# EasyEDA Pro project C108_STM32.eprj, board PCB3
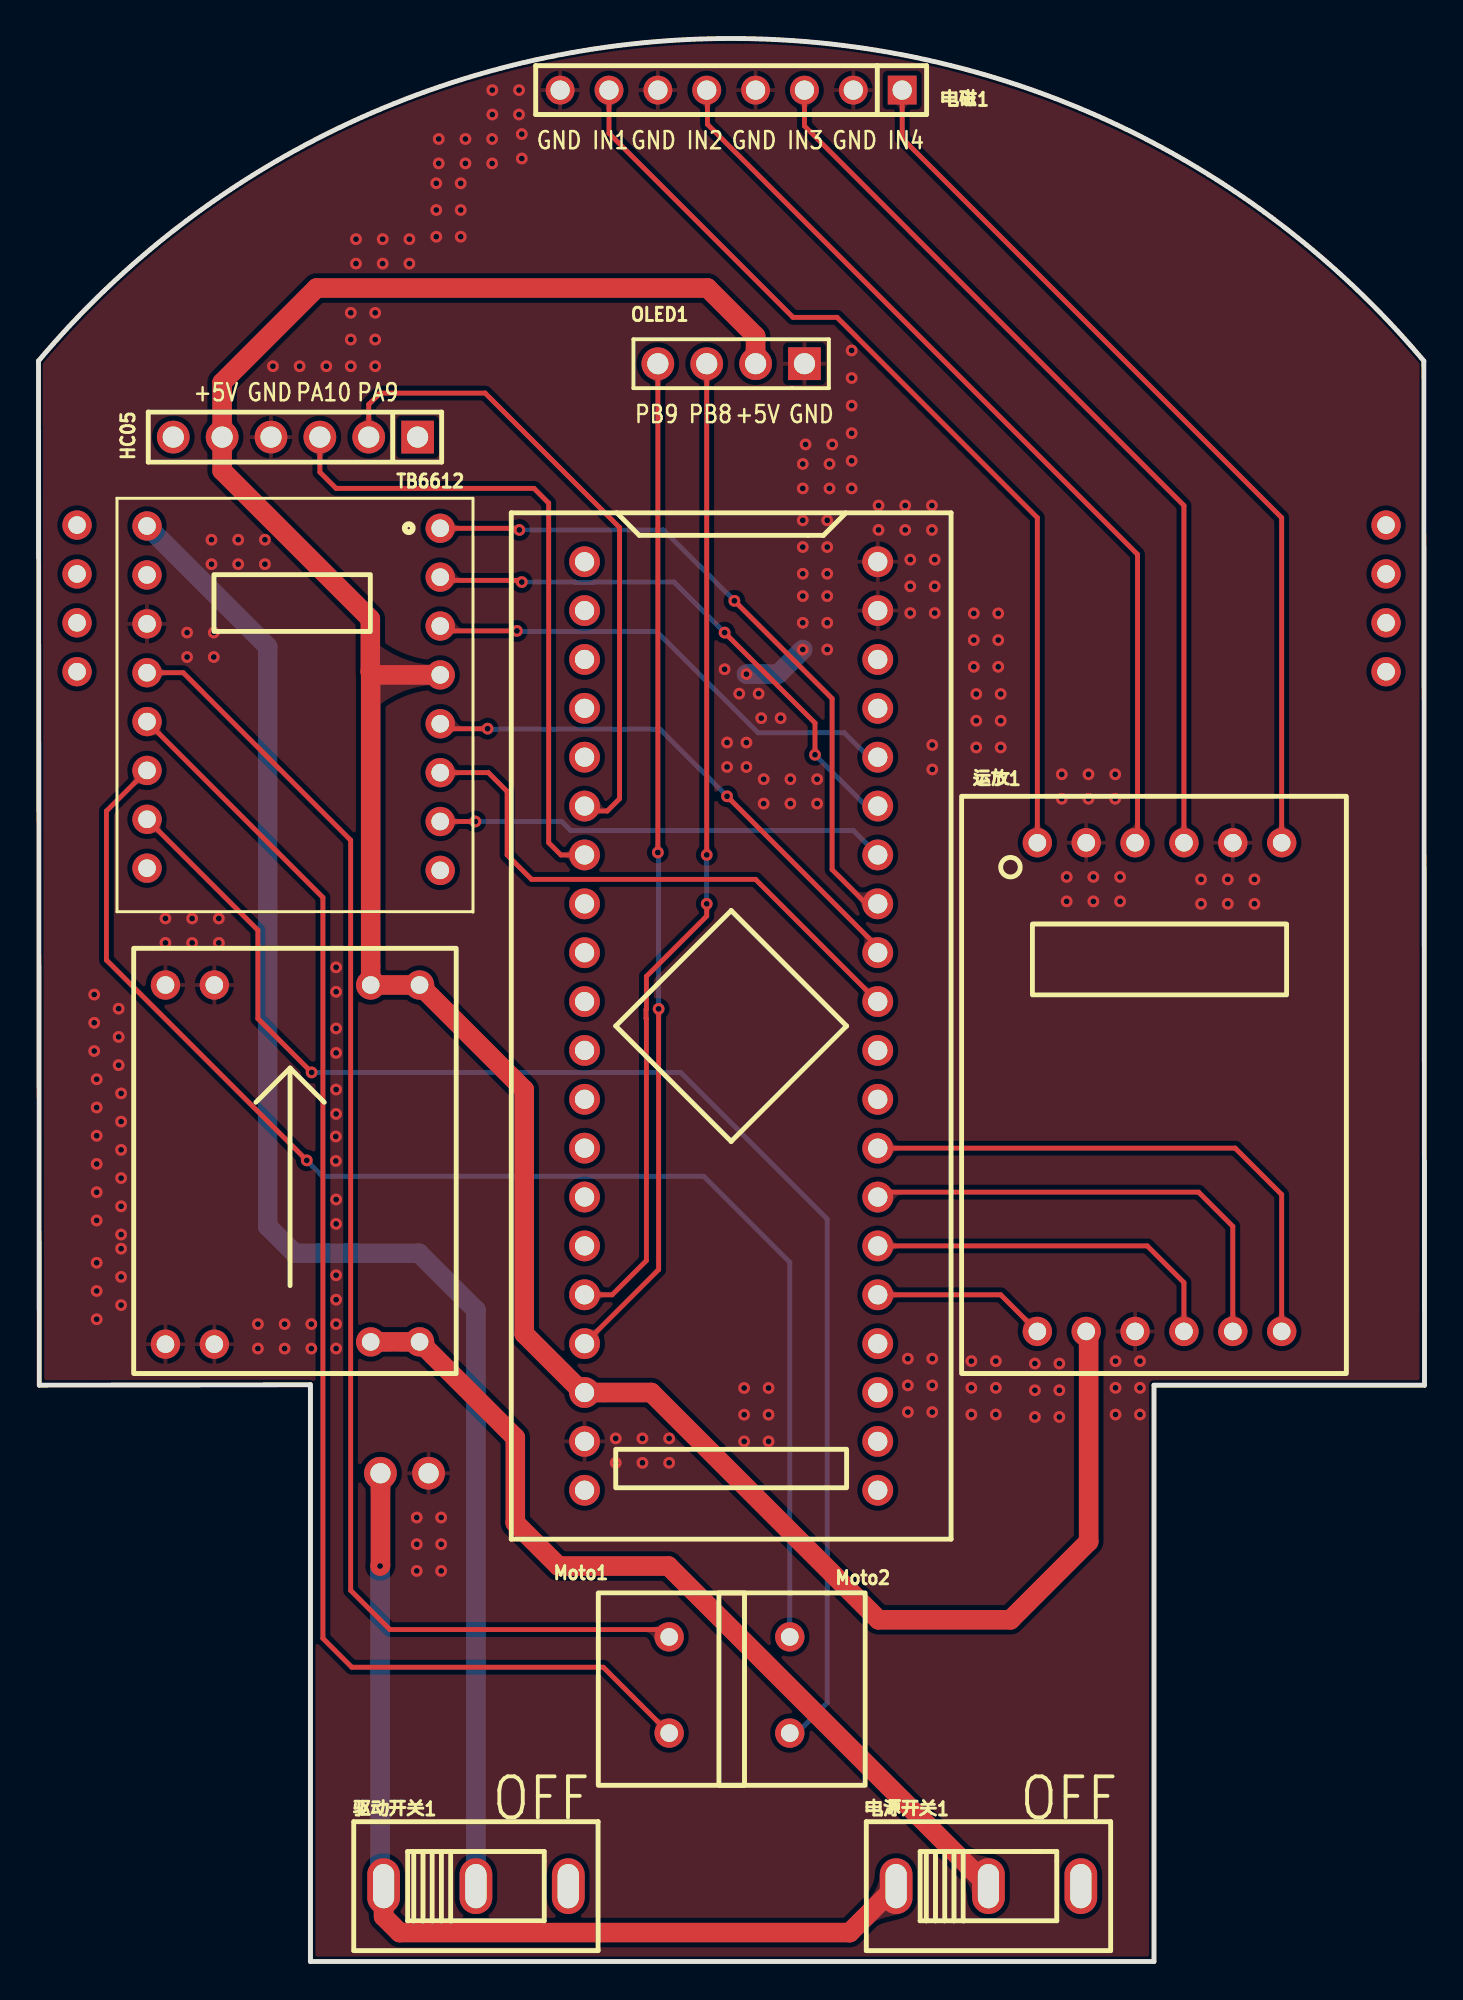
[diagram p13: board, top side]
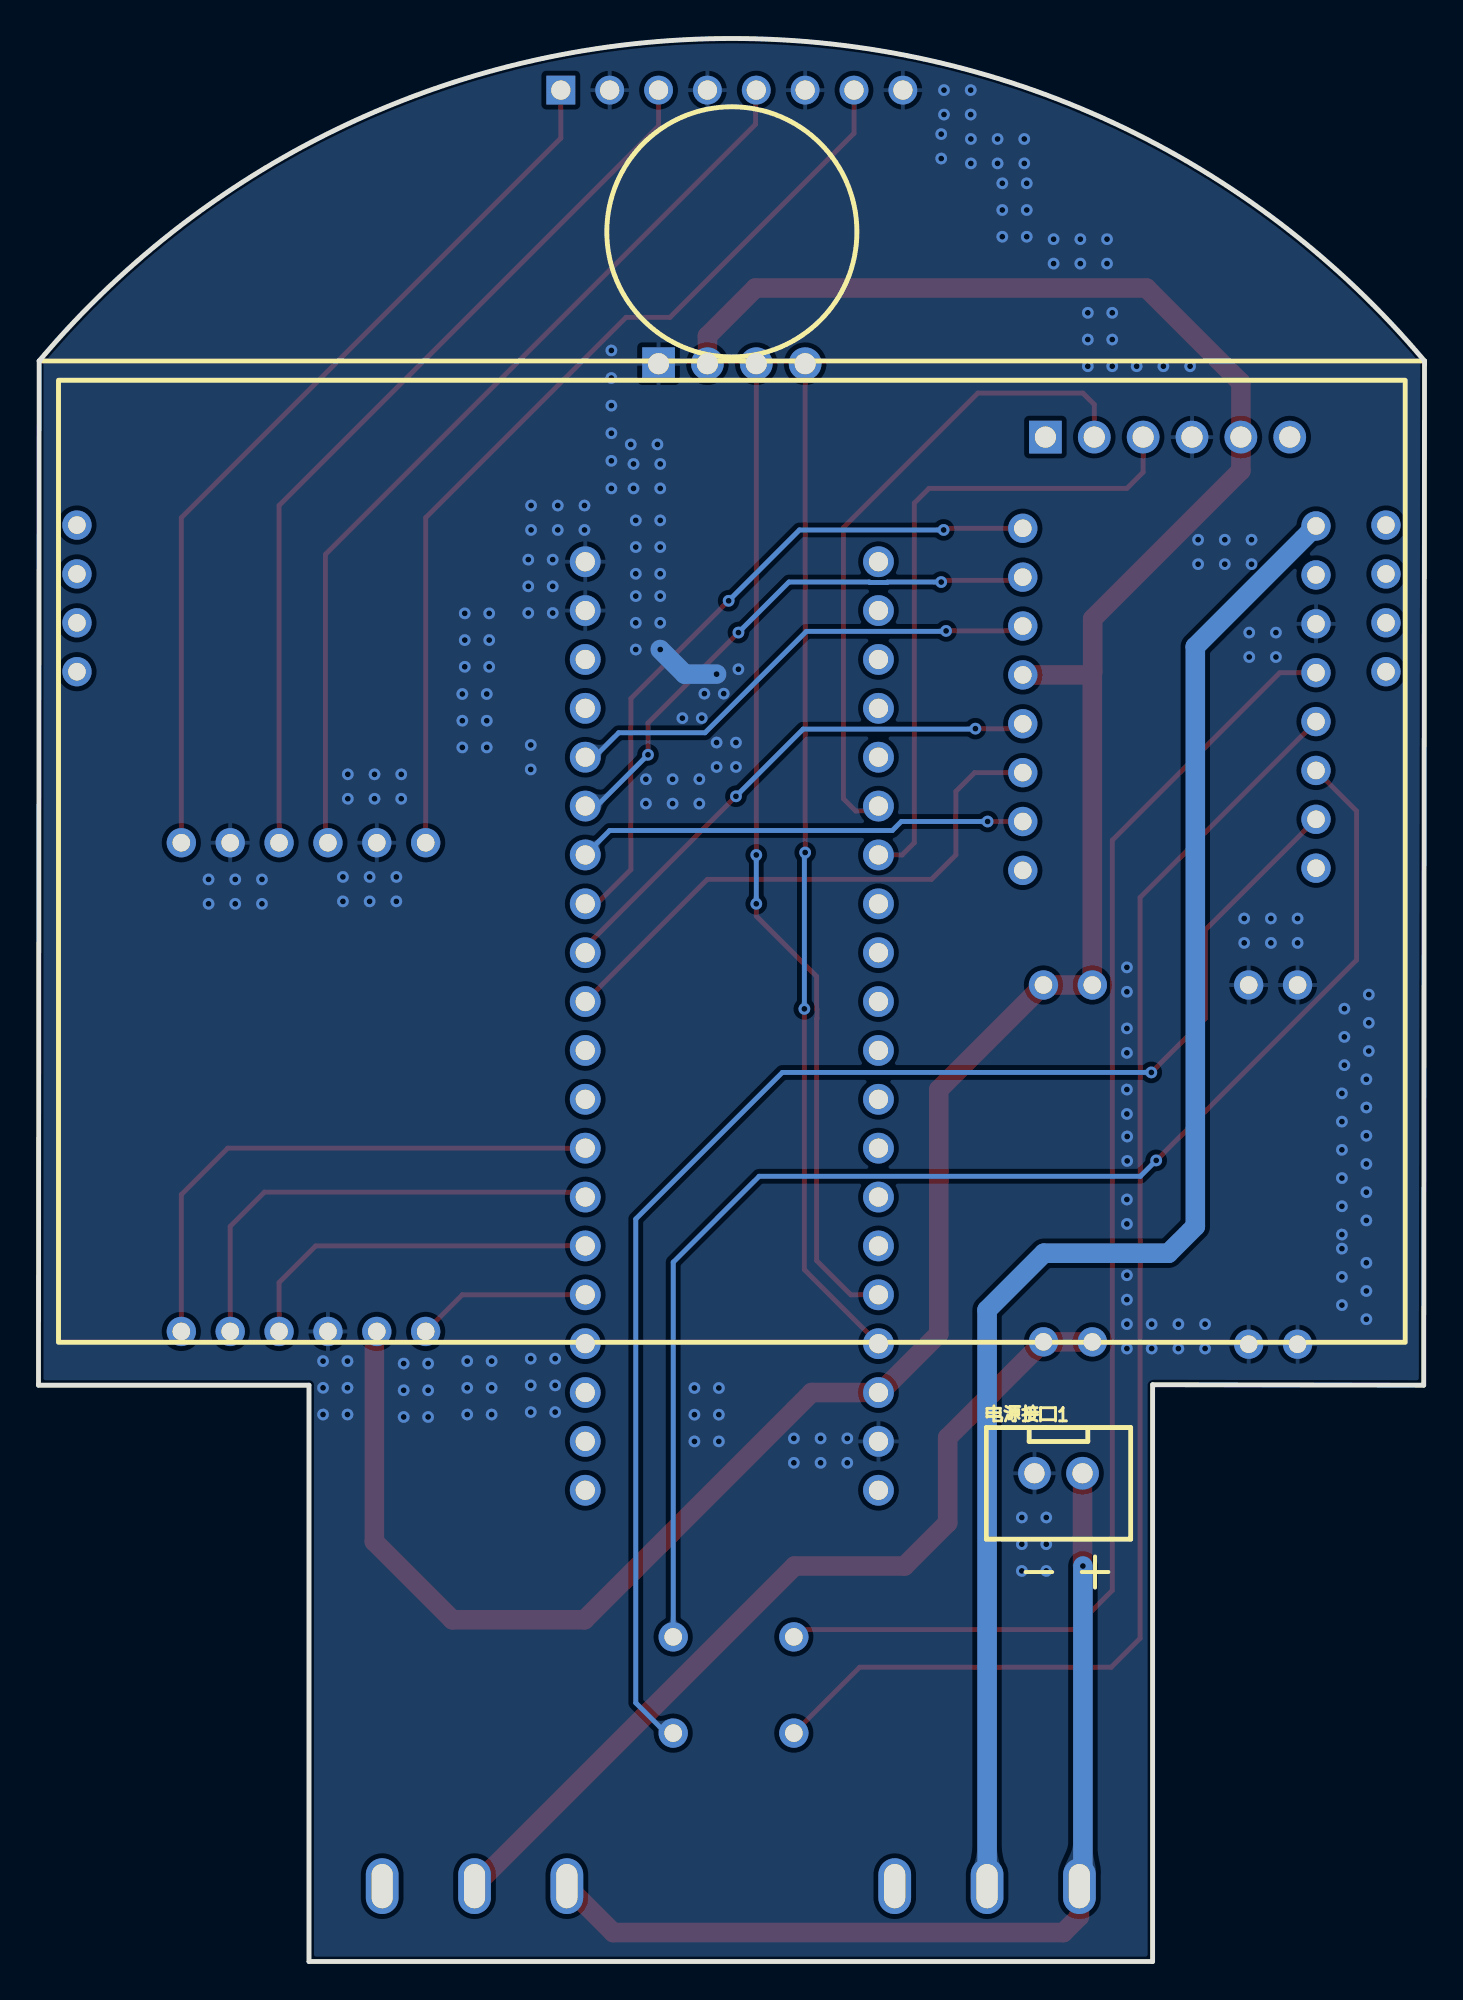
[diagram p14: board, bottom side, seen from below]

Outline 72.04 x 99.95 mm; copper layers: Top Layer, Bottom Layer. Coordinates in mm from the lower left corner of the outline.
Outline path: 0,83.19 0.04,29.95 14.13,29.98 14.13,0 57.98,0 57.98,29.95 72.04,29.95 72.01,83.19 arc(36,99.95) 0,83.19
Stack: Top Layer 0.035mm / Dielectric1 1.51mm FR4 er 4.5 / Bottom Layer 0.035mm

## Design rules (mm)
net PA9: DP1
net PA10: DP1
template: JLCPCB Capability(Two Layers Board)
spacing copperThickness1oz (default): track to track 0.102, other pairs 0.152 to 0.3
spacing copperThickness2oz: track to track 0.203, other pairs 0.152 to 0.3
track width copperThickness1oz (default): min 0.127, default 0.254, max 2.54
track width copperThickness2oz: min 0.203, default 0.254, max 2.54
differential pair differentialPair (default): width min 0.127, default 0.254, max 2.54; gap min 0.152, default 0.152
via viaSize (default): diameter min 0.5, default 0.61, max 10; hole min 0.3, default 0.305, max 6.3

## Placement (name value [footprint] x y rotation side)
HC05  HC05  [HDR-TH_6P-P2.54-V-M]  13.36 79.23 180 top
Moto1  -  [端子]  28.97 19.03 270 top
Moto2  -  [端子]  35.24 19.03 270 top
NOREF  -  [Pad_e2487]  70.04 69.58 0 top
NOREF#2  -  [Pad_e2481]  2 74.66 0 top
NOREF#3  -  [Pad_e2485]  70.04 74.66 0 top
NOREF#4  -  [Pad_e2484]  2 67.04 0 top
NOREF#5  -  [Pad_e2482]  2 72.12 0 top
NOREF#6  -  [Pad_e2486]  70.04 72.12 0 top
NOREF#7  -  [Pad_e2483]  2 69.58 0 top
NOREF#8  -  [Pad_e2488]  70.04 67.04 0 top
OLED1  0.96 OLED  [HDR-TH_4P-P2.54-V-M-1]  36 83.04 180 top
TB6612  -  [TB6612_Board]  12.93 77.55 270 top
U1  STM32F103C8T6-Card  [CONN-TH_L53.3-W22.9_STM32F103C8T6-CARD]  36 48.62 270 top
U12  -  [降压mini]  12.7 41.86 90 top
电源开关1  电源开关  [SW-TH_SHOU-HAN_SS12D10G4]  49.38 3.92 0 top
电源接口1  XH2.54*2P_直插  [CONN-TH_2P-P2.50-XH2.54-2P]  19.03 25.38 180 bottom
电磁1  电感  [HDR-TH_8P-P2.54-V-M]  36 97.26 180 top
运放1  -  [逐飞运放]  47.86 60.69 270 top
驱动开关1  驱动开关  [SW-TH_SHOU-HAN_SS12D10G4]  22.74 3.92 0 top

## Footprints (pads in the part's own frame, mm; a bottom-side part is the same pattern mirrored in y, then rotated)
CONN-TH_2P-P2.50-XH2.54-2P
  round 1.7 hole 1.05: 1(1.25,0) 2(-1.25,0)
CONN-TH_L53.3-W22.9_STM32F103C8T6-CARD
  round 1.6 hole 1: 1(-24.13,-7.62) 2(-21.59,-7.62) 3(-19.05,-7.62) 4(-16.51,-7.62) 5(-13.97,-7.62) 6(-11.43,-7.62) 7(-8.89,-7.62) 8(-6.35,-7.62) 9(-3.81,-7.62) 10(-1.27,-7.62) 11(1.27,-7.62) 12(3.81,-7.62) 13(6.35,-7.62) 14(8.89,-7.62) 15(11.43,-7.62) 16(13.97,-7.62) 17(16.51,-7.62) 18(19.05,-7.62) 19(21.59,-7.62) 20(24.13,-7.62) 21(24.13,7.62) 22(21.59,7.62) 23(19.05,7.62) 24(16.51,7.62) 25(13.97,7.62) 26(11.43,7.62) 27(8.89,7.62) 28(6.35,7.62) 29(3.81,7.62) 30(1.27,7.62) 31(-1.27,7.62) 32(-3.81,7.62) 33(-6.35,7.62) 34(-8.89,7.62) 35(-11.43,7.62) 36(-13.97,7.62) 37(-16.51,7.62) 38(-19.05,7.62) 39(-21.59,7.62) 40(-24.13,7.62)
HDR-TH_4P-P2.54-V-M-1
  rect 1.7x1.7 hole 1.1: 1(-3.81,0)
  round 1.7 hole 1.1: 2(-1.27,0) 3(1.27,0) 4(3.81,0)
HDR-TH_6P-P2.54-V-M
  rect 1.7x1.7 hole 1.1: 1(-6.35,0)
  round 1.7 hole 1.1: 2(-3.81,0) 3(-1.27,0) 4(1.27,0) 5(3.81,0) 6(6.35,0)
HDR-TH_8P-P2.54-V-M
  rect 1.5x1.5 hole 1: 1(-8.89,0)
  round 1.5 hole 1: 2(-6.35,0) 3(-3.81,0) 4(-1.27,0) 5(1.27,0) 6(3.81,0) 7(6.35,0) 8(8.89,0)
Pad_e2481
  round 1.524 hole 0.914: 1(0,0)
Pad_e2482
  round 1.524 hole 0.914: 2(0,0)
Pad_e2483
  round 1.524 hole 0.914: 3(0,0)
Pad_e2484
  round 1.524 hole 0.914: 4(0,0)
Pad_e2485
  round 1.524 hole 0.914: 1(0,0)
Pad_e2486
  round 1.524 hole 0.914: 2(0,0)
Pad_e2487
  round 1.524 hole 0.914: 3(0,0)
Pad_e2488
  round 1.524 hole 0.914: 4(0,0)
SW-TH_SHOU-HAN_SS12D10G4
  oval 1.7x2.9 hole 1.1x2.3: 1(-4.8,0) 2(0,0) 3(4.8,0)
TB6612_Board
  round 1.524 hole 0.914: 1(3.063,7.952) 2(5.603,7.952) 3(8.143,7.952) 4(10.683,7.952) 5(13.223,7.952) 6(15.763,7.952) 7(18.303,7.952) 8(20.843,7.952) 9(20.729,-7.288) 10(18.189,-7.288) 11(15.649,-7.288) 12(13.108,-7.288) 13(10.569,-7.288) 14(8.028,-7.288) 15(5.489,-7.288) 16(2.942,-7.288)
端子
  round 1.524 hole 0.914: 1(2.159,3.81) 2(7.159,3.81)
逐飞运放
  round 1.524 hole 0.914: 1(2.54,4.064) 2(2.54,6.604) 3(2.54,9.144) 4(2.54,11.684) 5(2.54,14.224) 6(2.54,16.764) 7(27.94,4.064) 8(27.94,6.604) 9(27.94,9.144) 10(27.94,11.684) 11(27.94,14.224) 12(27.94,16.764)
降压mini
  round 1.524 hole 0.914: 1(-9.779,6.096) 2(-9.779,3.556) 3(-9.659,-4.571) 4(-9.656,-7.112) 5(8.89,6.096) 6(8.89,3.556) 7(8.89,-4.571) 8(8.89,-7.112)

## Nets
As in the schematic, except:
GND: HC05.4 OLED1.1 TB6612.14 U1.19 U1.39 U1.40 U12.1 U12.2 U12.5 U12.6 电源接口1.2 电磁1.2 电磁1.4 电磁1.6 电磁1.8 运放1.2 运放1.5 运放1.9
$1N893: Moto1.2 TB6612.12
$1N914: U12.3 U12.4 电源开关1.2

Pads without a net: HC05 1 6; NOREF 3; NOREF#2 1; NOREF#3 1; NOREF#4 4; NOREF#5 2; NOREF#6 2; NOREF#7 3; NOREF#8 4; TB6612 8 9 15; U1 20 21 37 38; 电源开关1 3; 驱动开关1 3

## Via types
v1: diameter 0.61, hole 0.305, Top Layer to Bottom Layer, 235 vias

## Routing (per net, layer and track width the routed paths; a pad name or vN(x,y) marks a point on that pad's centre or on a via; arc(x,y) is an arc through that point)
12V+: length 51.1
  Top Layer w1.016: 17.78,25.38 17.78,20.57 v1(17.76,20.55) ; 驱动开关1.1 17.94,2.34 18.77,1.5 42.17,1.5 电源开关1.1
  Bottom Layer w1.016: 驱动开关1.1 17.76,4.1 v1(17.76,20.55)
+5V: length 141.5
  Top Layer w1.016: OLED1.2 37.27,84.48 34.78,86.98 14.45,86.98 9.55,82.07 HC05.5 9.55,77.48 17.25,69.78 17.25,67.04 17.42,66.87 ; 运放1.8 54.59,32.62 54.59,21.82 50.52,17.76 43.66,17.76 31.85,29.57 U1.18 28.3,29.57 25.25,32.62 25.25,45.31 U12.8 U12.7 17.27,66.87 17.42,66.87 ; 17.42,66.87 TB6612.4
GND: length 3.5
  Bottom Layer w1.016: v1(36.8,66.91) 38.45,66.91 v1(39.73,68.19)
  vias: v1(2.9,50.26) v1(2.9,48.79) v1(2.9,47.32) v1(3.02,45.85) v1(3.02,44.39) v1(3.02,42.92) v1(3.02,41.45) v1(3.02,39.98) v1(3.02,38.52) v1(3.02,36.32) v1(3.02,34.85) v1(3.02,33.38) v1(4.17,49.52) v1(4.17,48.05) v1(4.17,46.59) v1(4.29,45.12) v1(4.29,43.65) v1(4.29,42.19) v1(4.29,40.72) v1(4.29,39.25) v1(4.29,37.78) v1(4.29,37.05) v1(4.29,35.58) v1(4.29,34.12) v1(6.6,54.21) v1(6.6,52.94) v1(7.72,69.07) v1(7.72,67.8) v1(7.99,54.21) v1(7.99,52.94) v1(8.99,73.89) v1(8.99,72.62) v1(9.11,69.07) v1(9.11,67.8) v1(9.37,54.21) v1(9.37,52.94) v1(10.38,73.89) v1(10.38,72.62) v1(11.41,33.13) v1(11.41,31.86) v1(11.77,73.89) v1(11.77,72.62) v1(12.19,82.91) v1(12.79,33.13) v1(12.79,31.86) v1(13.57,82.91) v1(14.18,33.13) v1(14.18,31.86) v1(14.96,82.91) v1(15.47,51.67) v1(15.47,50.4) v1(15.47,48.49) v1(15.47,47.22) v1(15.47,45.32) v1(15.47,44.05) v1(15.46,42.88) v1(15.46,41.61) v1(15.47,39.6) v1(15.47,38.33) v1(15.47,35.67) v1(15.47,34.4) v1(15.47,33.13) v1(15.47,31.86) v1(16.23,85.69) v1(16.23,84.3) v1(16.23,82.91) v1(16.5,89.52) v1(16.5,88.25) v1(17.5,85.69) v1(17.5,84.3) v1(17.5,82.91) v1(17.89,89.52) v1(17.89,88.25) v1(19.28,89.52) v1(19.28,88.25) v1(19.66,23.08) v1(19.66,21.69) v1(19.66,20.3) v1(20.68,92.42) v1(20.68,91.03) v1(20.68,89.64) v1(20.8,94.72) v1(20.8,93.45) v1(20.93,23.08) v1(20.93,21.69) v1(20.93,20.3) v1(21.95,92.42) v1(21.95,91.03) v1(21.95,89.64) v1(22.19,94.72) v1(22.19,93.45) v1(23.59,97.26) v1(23.59,95.99) v1(23.58,94.72) v1(23.58,93.45) v1(24.98,97.26) v1(24.98,95.99) v1(25.12,94.98) v1(25.12,93.71) v1(30,27.19) v1(30,25.92) v1(31.39,27.19) v1(31.39,25.92) v1(32.78,27.19) v1(32.78,25.92) v1(35.66,67.16) v1(35.79,63.35) v1(35.79,62.08) v1(36.42,65.89) v1(36.68,29.81) v1(36.68,28.42) v1(36.68,27.03) v1(36.8,63.35) v1(36.8,62.08) v1(37.43,65.89) v1(37.57,64.62) v1(37.7,61.45) v1(37.7,60.18) v1(37.95,29.81) v1(37.95,28.42) v1(37.95,27.03) v1(38.58,64.62) v1(39.08,61.45) v1(39.08,60.18) v1(39.73,77.83) v1(39.73,76.56) v1(39.73,74.9) v1(39.73,73.51) v1(39.73,72.13) v1(39.73,70.97) v1(39.73,69.58) v1(39.87,78.85) v1(40.47,61.45) v1(40.47,60.18) v1(41,74.9) v1(41,73.51) v1(41,72.13) v1(41,70.97) v1(41,69.58) v1(41,68.19) v1(41.12,77.83) v1(41.12,76.56) v1(41.26,78.85) v1(42.27,83.73) v1(42.27,82.3) v1(42.27,80.86) v1(42.27,79.43) v1(42.27,78) v1(42.27,76.56) v1(43.66,75.67) v1(43.66,74.4) v1(45.05,75.67) v1(45.05,74.4) v1(45.19,31.33) v1(45.19,29.94) v1(45.19,28.56) v1(45.32,72.86) v1(45.32,71.47) v1(45.32,70.08) v1(46.44,75.67) v1(46.44,74.4) v1(46.46,63.23) v1(46.46,61.96) v1(46.46,31.33) v1(46.46,29.94) v1(46.46,28.56) v1(46.58,72.86) v1(46.58,71.47) v1(46.58,70.08) v1(48.49,31.21) v1(48.49,29.82) v1(48.49,28.43) v1(48.62,70.07) v1(48.62,68.68) v1(48.62,67.29) v1(48.74,65.88) v1(48.74,64.49) v1(48.74,63.1) v1(49.76,31.21) v1(49.76,29.82) v1(49.76,28.43) v1(49.89,70.07) v1(49.89,68.68) v1(49.89,67.29) v1(50.01,65.88) v1(50.01,64.49) v1(50.01,63.1) v1(51.79,31.08) v1(51.79,29.69) v1(51.79,28.3) v1(53.06,31.08) v1(53.06,29.69) v1(53.06,28.3) v1(53.19,61.7) v1(53.19,60.43) v1(53.44,56.37) v1(53.44,55.1) v1(54.58,61.7) v1(54.58,60.43) v1(54.83,56.37) v1(54.83,55.1) v1(55.97,61.7) v1(55.97,60.43) v1(55.98,31.21) v1(55.98,29.82) v1(55.98,28.43) v1(56.22,56.37) v1(56.22,55.1) v1(57.25,31.21) v1(57.25,29.82) v1(57.25,28.43) v1(60.43,56.24) v1(60.43,54.97) v1(61.82,56.24) v1(61.82,54.97) v1(63.2,56.24) v1(63.2,54.97)
PA0: length 9.1
  Top Layer w0.254: 运放1.7 50.01,34.65 U1.25
PA1: length 19.2
  Top Layer w0.254: 43.62,37.19 57.63,37.19 59.54,35.29 运放1.10
PA2: length 24.8
  Top Layer w0.254: 运放1.11 62.08,38.21 60.3,39.99 43.88,39.99 U1.27
PA3: length 29.1
  Top Layer w0.254: U1.28 62.21,42.27 64.62,39.86 运放1.12
PA6: length 29.6
  Top Layer w0.254: TB6612.6 23.38,61.79 24.36,60.81 24.36,57.51 25.63,56.24 37.27,56.24 U1.31
PA7: length 27.8
  Top Layer w0.254: U1.32 43.62,52.73 v1(35.79,60.56) ; v1(23.34,64.08) 23.34,64.07 21.14,64.07 TB6612.5
  Bottom Layer w0.254: v1(35.79,60.56) 32.3,64.05 23.37,64.05 v1(23.34,64.08)
PA9: length 34.2
  Top Layer w0.254: U1.6 28.64,59.8 29.57,59.8 30.2,60.43 30.2,74.53 23.22,81.51 17.76,81.51 17.17,80.92 HC05.2
PA10: length 34.2
  Top Layer w0.254: HC05.3 14.63,77.41 15.47,76.56 25.76,76.56 26.52,75.8 26.52,58.15 27.15,57.51 U1.7
PB0: length 36
  Top Layer w0.254: v1(24.99,74.4) 24.91,74.49 TB6612.1 ; 43.62,54.97 43.03,54.97 41.25,56.75 41.25,65.64 v1(36.17,70.72)
  Bottom Layer w0.254: v1(24.99,74.4) 32.49,74.4 v1(36.17,70.72)
PB1: length 23.5
  Top Layer w0.254: TB6612.7 v1(22.71,59.25)
  Bottom Layer w0.254: U1.34 42.35,58.78 27.66,58.78 27.19,59.25 v1(22.71,59.25)
PB8: length 51.9
  Top Layer w0.254: U1.16 29.82,34.65 31.6,36.43 31.6,49 31.58,49.02 31.58,49.48 31.6,49.5 31.6,51.2 34.73,54.34 v1(34.73,54.97) ; OLED1.3 v1(34.73,57.51)
  Bottom Layer w0.254: v1(34.73,57.51) v1(34.73,54.97)
PB9: length 52.5
  Top Layer w0.254: OLED1.4 v1(32.19,57.64) ; v1(32.23,49.51) 32.23,35.96 28.38,32.11
  Bottom Layer w0.254: v1(32.19,57.64) 32.23,57.6 v1(32.23,49.51)
PB10: length 28.7
  Top Layer w0.254: v1(40.36,62.72) 40.36,64.37 v1(35.66,69.07) ; v1(25.12,71.7) 25.03,71.78 21.05,71.78 TB6612.2
  Bottom Layer w0.254: U1.35 43.03,60.05 v1(40.36,62.72) ; v1(25.12,71.7) 27.91,71.7 27.94,71.67 28.83,71.67 28.85,71.7 33.04,71.7 v1(35.66,69.07)
PB11: length 25.6
  Top Layer w0.254: v1(24.87,69.16) 21.14,69.16 TB6612.3
  Bottom Layer w0.254: v1(24.87,69.16) 24.89,69.13 32.13,69.13 37.4,63.86 41.89,63.86 43.16,62.59 U1.36
$1N892: length 70.7
  Top Layer w0.254: Moto1.1 32.4,17.25 18.26,17.25 16.23,19.29 16.23,58.28 7.52,66.98 TB6612.13
$1N893: length 71.5
  Top Layer w0.254: Moto1.2 29.36,15.3 16.28,15.3 14.78,16.8 14.78,55.3 TB6612.12
$1N894: length 72.2
  Top Layer w0.254: v1(13.95,41.64) 3.53,52.05 3.53,59.79 TB6612.11
  Bottom Layer w0.254: Moto2.1 39.05,36.34 34.58,40.81 14.77,40.81 v1(13.95,41.64)
$1N895: length 74.4
  Top Layer w0.254: v1(14.2,46.21) 11.41,49 11.41,53.6 TB6612.10
  Bottom Layer w0.254: v1(14.2,46.21) 33.38,46.21 41,38.59 41,13.44 39.43,11.87 Moto2.2
$1N906: length 49.7
  Top Layer w0.254: 运放1.1 51.92,75.04 41.51,85.45 39.22,85.45 29.65,95.02 电磁1.7
$1N907: length 48.4
  Top Layer w0.254: 电磁1.5 34.77,97.22 34.77,95.48 57.13,73.13 57.13,58.27 运放1.3
$1N908: length 47.3
  Top Layer w0.254: 电磁1.3 39.81,95.4 59.54,75.67 运放1.4
$1N909: length 47.3
  Top Layer w0.254: 运放1.6 64.62,75.04 44.89,94.76 44.89,97.26
$1N914: length 46.4
  Top Layer w1.016: U12.3 17.27,32.21 U12.4 24.78,27.23 24.78,22.8 27.03,20.55 32.74,20.55 电源开关1.2
$1N915: length 81.6
  Bottom Layer w1.016: 驱动开关1.2 22.74,33.86 19.79,36.81 13.31,36.81 11.91,38.21 11.91,68.34 5.64,74.61

## Copper pours and planes (outline as drawn; the poured copper is in the pictures)
GND on Top Layer: -0.53,99.68 76.3,99.68 76.3,-3.19 -0.53,-3.19
GND on Bottom Layer: -5.36,106.28 80.62,106.28 80.62,-6.24 -5.36,-6.24

Small or netless copper shapes (teardrops, artwork), in the pictures only: 73 on Top Layer, 23 on Bottom Layer

## Text on the board
Bottom Silkscreen Layer: + | -
Top Silkscreen Layer: GND | IN1 | IN2 | IN3 | IN4 | +5V | PA10 | PA9 | PB9 | PB8 | OFF
